# EasyEDA Pro project kuafu01_030内部老化方案.eprj, board PCB4 (continued)
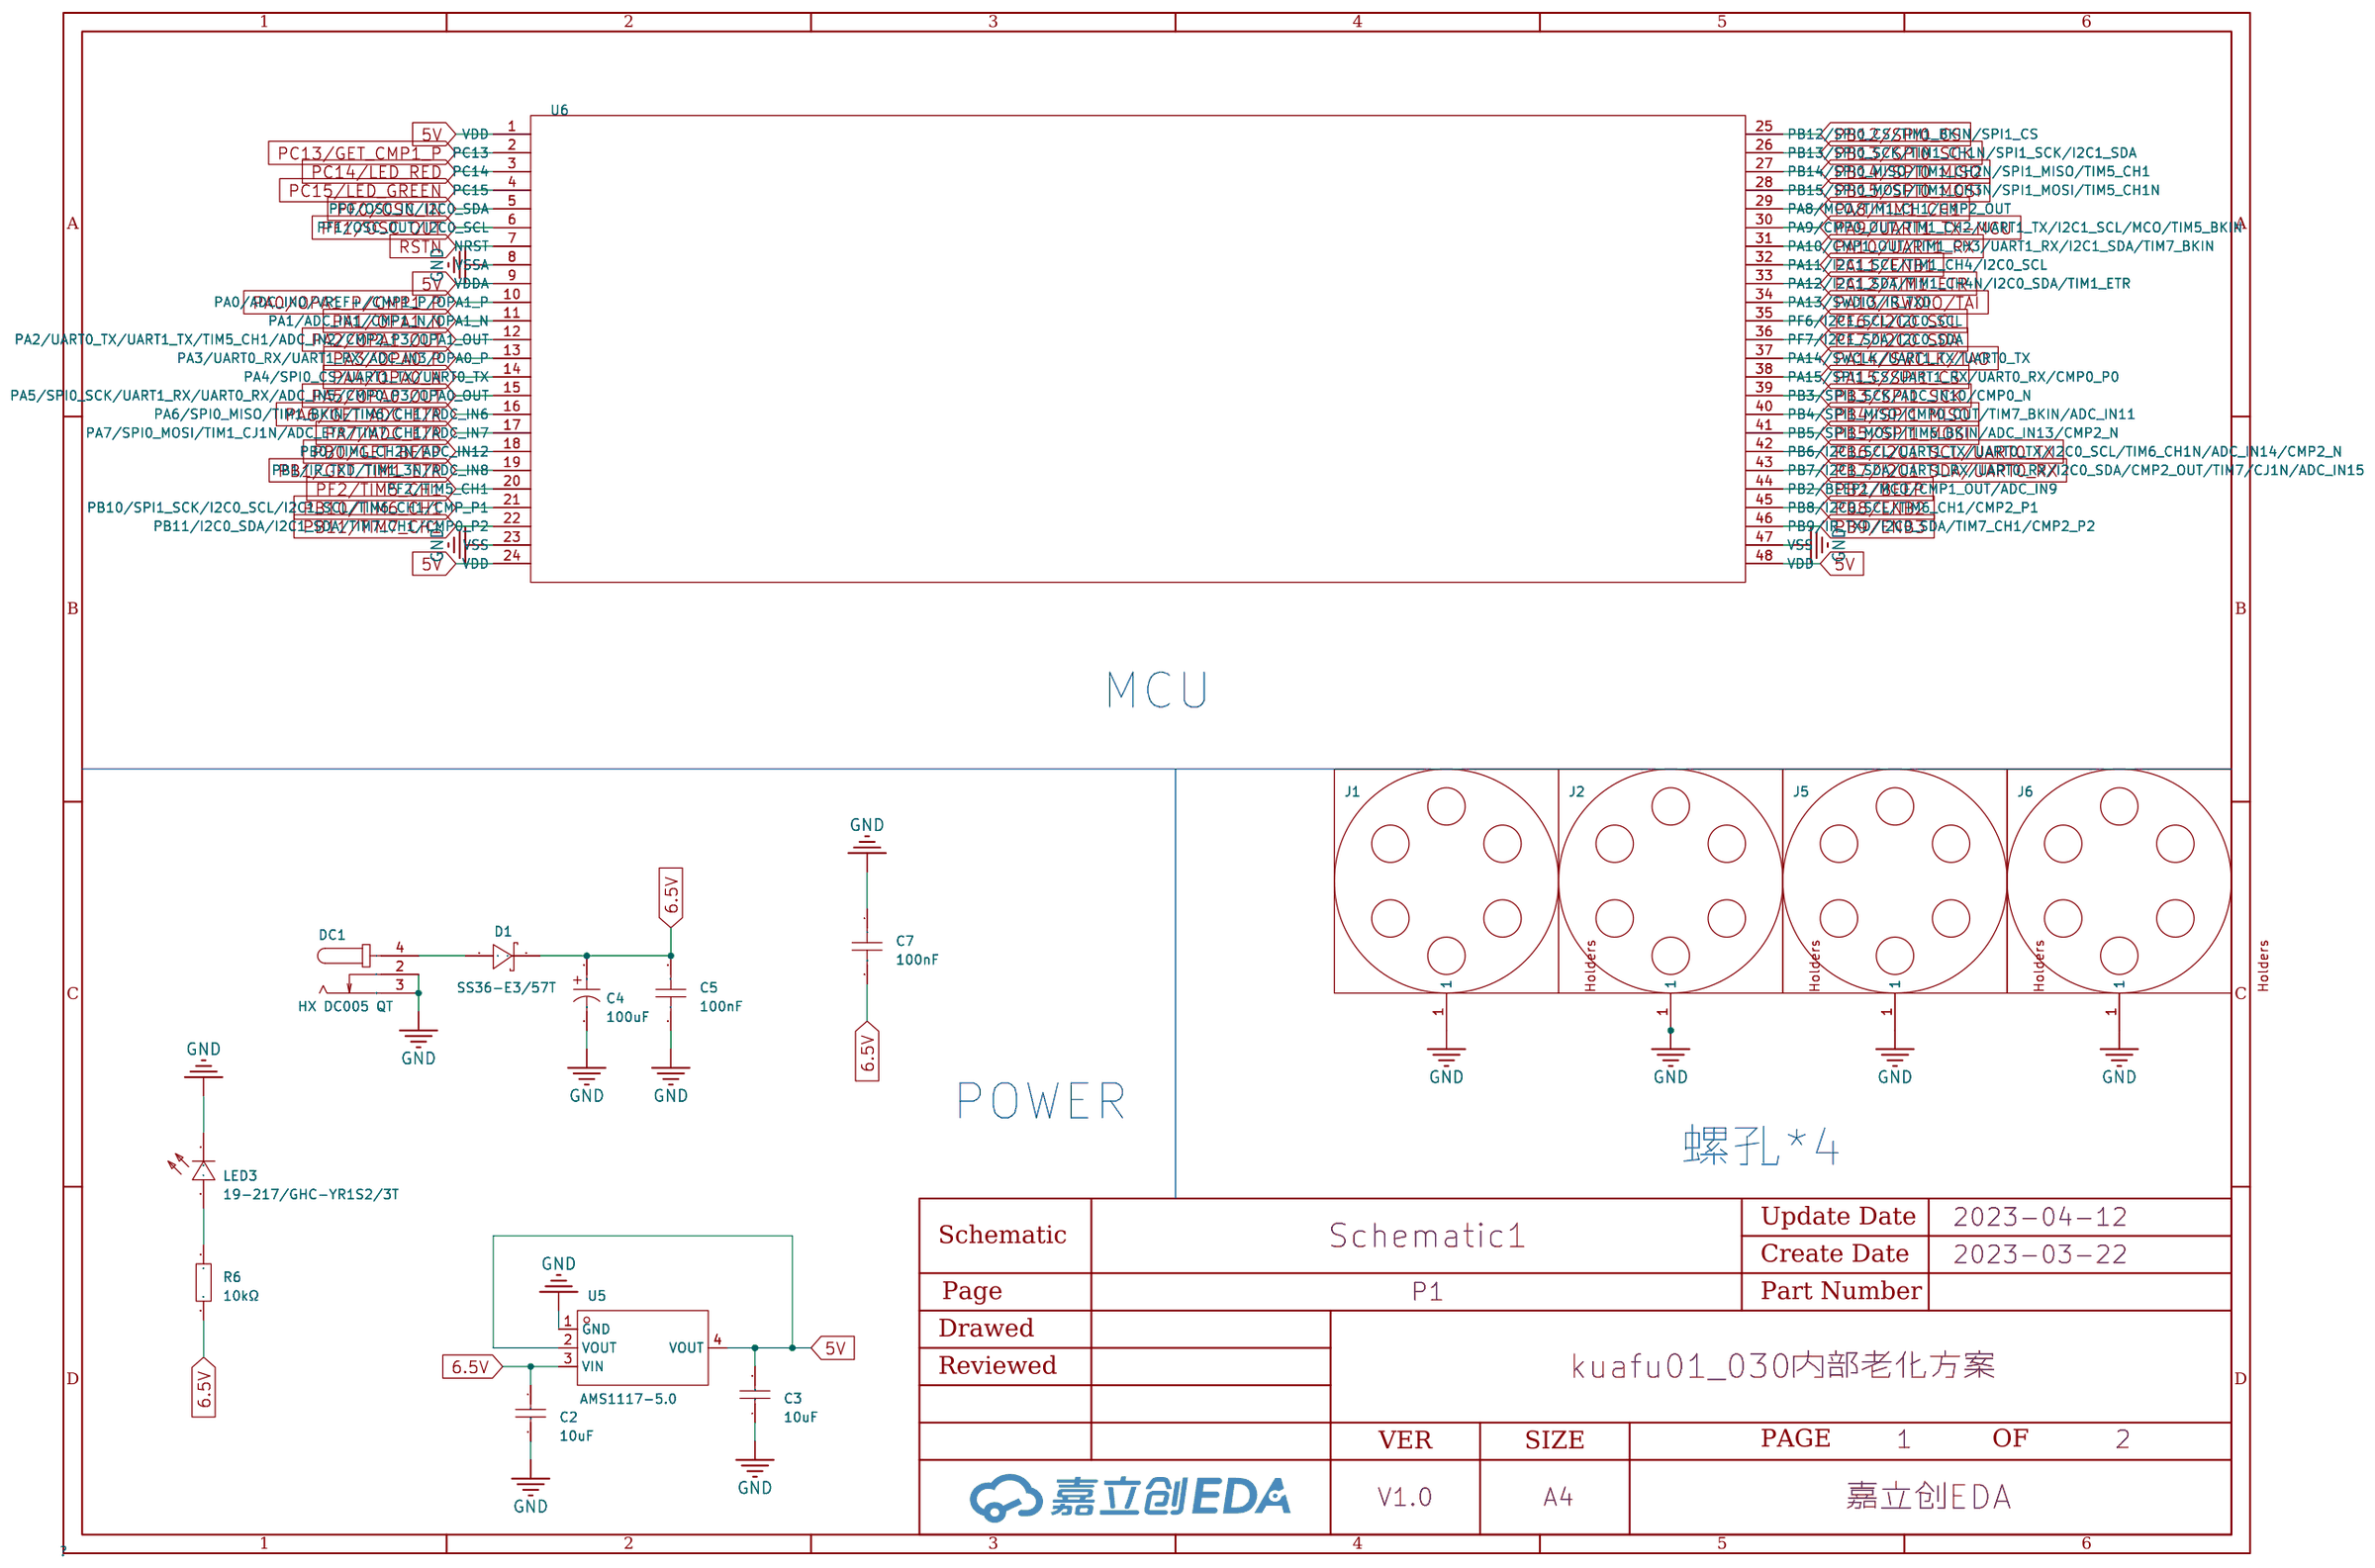
[diagram p0: P1]
## Routing (per net, layer and track width the routed paths; a pad name or vN(x,y) marks a point on that pad's centre or on a via; arc(x,y) is an arc through that point) (continued)
  Bottom Layer w0.254: v1(211.8,102.32) 211.9,102.22 211.9,94.96 221.88,84.97 221.88,79.05 v1(221.52,78.68) ; v1(272.31,332.68) 272.68,333.05 272.68,338.97 262.7,348.96 262.7,356.22 v1(262.6,356.32) ; v1(211.8,254.72) 211.9,254.62 211.9,247.36 221.88,237.37 221.88,231.45 v1(221.52,231.08) ; v1(213.67,291.07) 213.67,289.81 218.33,285.15 218.33,282.37 ; v1(59.4,254.72) 59.5,254.62 59.5,247.36 69.48,237.37 69.48,231.45 v1(69.11,231.08) ; v1(112.07,138.67) 112.07,137.41 116.73,132.75 116.73,129.97 ; v1(211.8,356.32) 211.9,356.22 211.9,348.96 221.88,338.97 221.88,333.05 v1(221.52,332.68) ; v1(69.11,129.48) 69.48,129.85 69.48,135.77 59.5,145.76 59.5,153.02 v1(59.4,153.12) ; 167.53,333.17 167.53,335.95 162.87,340.61 v1(162.87,341.88) ; 218.33,79.17 218.33,81.95 213.67,86.61 v1(213.67,87.88) ; v1(323.12,78.68) 323.48,79.05 323.48,84.97 313.5,94.96 313.5,102.22 v1(313.4,102.32) ; v1(110.2,51.52) 110.3,51.42 110.3,44.16 120.28,34.17 120.28,28.25 v1(119.91,27.88) ; 269.13,333.17 269.13,335.95 264.47,340.61 v1(264.47,341.88) ; v1(119.91,332.68) 120.28,333.05 120.28,338.97 110.3,348.96 110.3,356.22 v1(110.2,356.32) ; v1(313.4,254.72) 313.5,254.62 313.5,247.36 323.48,237.37 323.48,231.45 v1(323.12,231.08) ; v1(119.91,78.68) 120.28,79.05 120.28,84.97 110.3,94.96 110.3,102.22 v1(110.2,102.32) ; v1(162.87,138.67) 162.87,137.41 167.53,132.75 167.53,129.97 ; v1(59.4,203.92) 59.5,203.82 59.5,196.56 69.48,186.57 69.48,180.65 v1(69.11,180.28) ; 269.13,79.17 269.13,81.95 264.47,86.61 v1(264.47,87.88) ; v1(119.91,129.48) 120.28,129.85 120.28,135.77 110.3,145.76 110.3,153.02 v1(110.2,153.12) ; 65.93,28.37 65.93,31.15 61.27,35.81 v1(61.27,37.07) ; v1(161,153.12) 161.1,153.02 161.1,145.76 171.08,135.77 171.08,129.85 v1(170.72,129.48) ; v1(112.07,240.27) 112.07,239.01 116.73,234.35 116.73,231.57 ; v1(110.2,203.92) 110.3,203.82 110.3,196.56 120.28,186.57 120.28,180.65 v1(119.91,180.28) ; v1(170.72,78.68) 171.08,79.05 171.08,84.97 161.1,94.96 161.1,102.22 v1(161,102.32) ; 319.93,180.77 319.93,183.55 315.27,188.21 v1(315.27,189.47) ; v1(211.8,51.52) 211.9,51.42 211.9,44.16 221.88,34.17 221.88,28.25 v1(221.52,27.88) ; v1(61.27,87.88) 61.27,86.61 65.93,81.95 65.93,79.17 ; v1(110.2,254.72) 110.3,254.62 110.3,247.36 120.28,237.37 120.28,231.45 v1(119.91,231.08) ; v1(262.6,51.52) 262.7,51.42 262.7,44.16 272.68,34.17 272.68,28.25 v1(272.31,27.88) ; v1(59.4,305.52) 59.5,305.42 59.5,298.16 69.48,288.17 69.48,282.25 v1(69.11,281.88) ; v1(170.72,180.28) 171.08,180.65 171.08,186.57 161.1,196.56 161.1,203.82 v1(161,203.92) ; 269.13,231.57 269.13,234.35 264.47,239.01 v1(264.47,240.27) ; v1(61.27,138.67) 61.27,137.41 65.93,132.75 65.93,129.97 ; 65.93,180.77 65.93,183.55 61.27,188.21 v1(61.27,189.47) ; 269.13,28.37 269.13,31.15 264.47,35.81 v1(264.47,37.07) ; 116.73,333.17 116.73,335.95 112.07,340.61 v1(112.07,341.88) ; 167.53,231.57 167.53,234.35 162.87,239.01 v1(162.87,240.27) ; v1(313.4,203.92) 313.5,203.82 313.5,196.56 323.48,186.57 323.48,180.65 v1(323.12,180.28) ; 319.93,129.97 319.93,132.75 315.27,137.41 v1(315.27,138.67) ; v1(161,51.52) 161.1,51.42 161.1,44.16 171.08,34.17 171.08,28.25 v1(170.72,27.88) ; v1(315.27,341.88) 315.27,340.61 319.93,335.95 319.93,333.17 ; 65.93,282.37 65.93,285.15 61.27,289.81 v1(61.27,291.07) ; v1(262.6,203.92) 262.7,203.82 262.7,196.56 272.68,186.57 272.68,180.65 v1(272.31,180.28) ; v1(170.72,281.88) 171.08,282.25 171.08,288.17 161.1,298.16 161.1,305.42 v1(161,305.52) ; v1(69.11,78.68) 69.48,79.05 69.48,84.97 59.5,94.96 59.5,102.22 v1(59.4,102.32) ; 167.53,180.77 167.53,183.55 162.87,188.21 v1(162.87,189.47) ; v1(315.27,291.07) 315.27,289.81 319.93,285.15 319.93,282.37 ; 65.93,231.57 65.93,234.35 61.27,239.01 v1(61.27,240.27) ; v1(262.6,102.32) 262.7,102.22 262.7,94.96 272.68,84.97 272.68,79.05 v1(272.31,78.68) ; v1(110.2,305.52) 110.3,305.42 110.3,298.16 120.28,288.17 120.28,282.25 v1(119.91,281.88) ; v1(313.4,305.52) 313.5,305.42 313.5,298.16 323.48,288.17 323.48,282.25 v1(323.12,281.88) ; v1(272.31,231.08) 272.68,231.45 272.68,237.37 262.7,247.36 262.7,254.62 v1(262.6,254.72) ; v1(112.07,87.88) 112.07,86.61 116.73,81.95 116.73,79.17 ; v1(264.47,291.07) 264.47,289.81 269.13,285.15 269.13,282.37 ; v1(313.4,356.32) 313.5,356.22 313.5,348.96 323.48,338.97 323.48,333.05 v1(323.12,332.68) ; v1(112.07,189.47) 112.07,188.21 116.73,183.55 116.73,180.77 ; v1(313.4,153.12) 313.5,153.02 313.5,145.76 323.48,135.77 323.48,129.85 v1(323.12,129.48) ; v1(211.8,305.52) 211.9,305.42 211.9,298.16 221.88,288.17 221.88,282.25 v1(221.52,281.88) ; v1(170.72,332.68) 171.08,333.05 171.08,338.97 161.1,348.96 161.1,356.22 v1(161,356.32) ; v1(221.52,180.28) 221.88,180.65 221.88,186.57 211.9,196.56 211.9,203.82 v1(211.8,203.92) ; 116.73,28.37 116.73,31.15 112.07,35.81 v1(112.07,37.07) ; 218.33,129.97 218.33,132.75 213.67,137.41 v1(213.67,138.67) ; v1(221.52,129.48) 221.88,129.85 221.88,135.77 211.9,145.76 211.9,153.02 v1(211.8,153.12) ; 319.93,231.57 319.93,234.35 315.27,239.01 v1(315.27,240.27) ; 269.13,129.97 269.13,132.75 264.47,137.41 v1(264.47,138.67) ; 218.33,180.77 218.33,183.55 213.67,188.21 v1(213.67,189.47) ; v1(262.6,305.52) 262.7,305.42 262.7,298.16 272.68,288.17 272.68,282.25 v1(272.31,281.88) ; v1(162.87,37.07) 162.87,35.81 167.53,31.15 167.53,28.37 ; v1(162.87,87.88) 162.87,86.61 167.53,81.95 167.53,79.17 ; v1(162.87,291.07) 162.87,289.81 167.53,285.15 167.53,282.37 ; v1(213.67,37.07) 213.67,35.81 218.33,31.15 218.33,28.37 ; v1(112.07,291.07) 112.07,289.81 116.73,285.15 116.73,282.37 ; 319.93,79.17 319.93,81.95 315.27,86.61 v1(315.27,87.88) ; v1(272.31,129.48) 272.68,129.85 272.68,135.77 262.7,145.76 262.7,153.02 v1(262.6,153.12) ; v1(264.47,189.47) 264.47,188.21 269.13,183.55 269.13,180.77 ; v1(170.72,231.08) 171.08,231.45 171.08,237.37 161.1,247.36 161.1,254.62 v1(161,254.72) ; v1(69.11,27.88) 69.48,28.25 69.48,34.17 59.5,44.16 59.5,51.42 v1(59.4,51.52) ; 218.33,333.17 218.33,335.95 213.67,340.61 v1(213.67,341.88) ; v1(213.67,240.27) 213.67,239.01 218.33,234.35 218.33,231.57
PA10/UART1_RX: length 1261.4
  Top Layer w0.254: v1(161.57,240.25) 161.57,241.4 158.16,244.81 ; 259.06,77.79 266.28,77.79 268.13,79.63 268.13,80.01 v1(268.12,80.02) 268.14,80.04 268.14,80.99 266.85,82.28 264.69,82.28 ; 259.06,128.59 266.28,128.59 268.13,130.44 268.13,130.81 v1(268.12,130.82) 268.14,130.84 268.14,131.79 266.85,133.08 264.69,133.08 ; 310.56,143.21 313.97,139.8 v1(313.97,138.65) ; 107.36,92.41 110.77,89 v1(110.77,87.85) ; 208.26,179.39 215.48,179.39 217.33,181.23 217.33,181.61 v1(217.32,181.62) 217.34,181.64 217.34,182.59 216.05,183.88 213.89,183.88 ; v1(263.17,87.85) 263.17,89 259.76,92.41 ; v1(212.37,37.05) 212.37,38.2 208.96,41.61 ; 112.29,285.48 114.45,285.48 115.74,284.19 115.74,283.24 v1(115.72,283.22) 115.73,283.21 115.73,282.83 113.88,280.99 106.66,280.99 ; 208.96,295.61 212.37,292.2 v1(212.37,291.05) ; 264.69,234.68 266.85,234.68 268.14,233.39 268.14,232.44 v1(268.12,232.42) 268.13,232.41 268.13,232.03 266.28,230.19 259.06,230.19 ; v1(161.57,189.45) 161.57,190.6 158.16,194.01 ; 157.46,331.79 164.68,331.79 166.53,333.63 166.53,334.01 v1(166.52,334.02) 166.54,334.04 166.54,334.99 165.25,336.28 163.09,336.28 ; 55.86,77.79 63.08,77.79 64.93,79.63 64.93,80.01 v1(64.92,80.02) 64.94,80.04 64.94,80.99 63.65,82.28 61.49,82.28 ; 107.36,41.61 110.77,38.2 v1(110.77,37.05) ; 208.26,128.59 215.48,128.59 217.33,130.44 217.33,130.81 v1(217.32,130.82) 217.34,130.84 217.34,131.79 216.05,133.08 213.89,133.08 ; 55.86,128.59 63.08,128.59 64.93,130.44 64.93,130.81 v1(64.92,130.82) 64.94,130.84 64.94,131.79 63.65,133.08 61.49,133.08 ; 56.56,244.81 59.97,241.4 v1(59.97,240.25) ; 259.06,179.39 266.28,179.39 268.13,181.23 268.13,181.61 v1(268.12,181.62) 268.14,181.64 268.14,182.59 266.85,183.88 264.69,183.88 ; 264.69,336.28 266.85,336.28 268.14,334.99 268.14,334.04 v1(268.12,334.02) 268.13,334.01 268.13,333.63 266.28,331.79 259.06,331.79 ; 315.49,183.88 317.65,183.88 318.94,182.59 318.94,181.64 v1(318.92,181.62) 318.93,181.61 318.93,181.23 317.08,179.39 309.86,179.39 ; 264.69,31.48 266.85,31.48 268.14,30.19 268.14,29.24 v1(268.12,29.22) 268.13,29.21 268.13,28.83 266.28,26.99 259.06,26.99 ; 315.49,82.28 317.65,82.28 318.94,80.99 318.94,80.04 v1(318.92,80.02) 318.93,80.01 318.93,79.63 317.08,77.79 309.86,77.79 ; v1(110.77,240.25) 110.77,241.4 107.36,244.81 ; v1(263.17,37.05) 263.17,38.2 259.76,41.61 ; v1(212.37,138.65) 212.37,139.8 208.96,143.21 ; 259.76,194.01 263.17,190.6 v1(263.17,189.45) ; 107.36,194.01 110.77,190.6 v1(110.77,189.45) ; 157.46,26.99 164.68,26.99 166.53,28.83 166.53,29.21 v1(166.52,29.22) 166.54,29.24 166.54,30.19 165.25,31.48 163.09,31.48 ; 106.66,230.19 113.88,230.19 115.73,232.03 115.73,232.41 v1(115.72,232.42) 115.74,232.44 115.74,233.39 114.45,234.68 112.29,234.68 ; 106.66,26.99 113.88,26.99 115.73,28.83 115.73,29.21 v1(115.72,29.22) 115.74,29.24 115.74,30.19 114.45,31.48 112.29,31.48 ; 309.86,280.99 317.08,280.99 318.93,282.83 318.93,283.21 v1(318.92,283.22) 318.94,283.24 318.94,284.19 317.65,285.48 315.49,285.48 ; 208.26,26.99 215.48,26.99 217.33,28.83 217.33,29.21 v1(217.32,29.22) 217.34,29.24 217.34,30.19 216.05,31.48 213.89,31.48 ; 112.29,183.88 114.45,183.88 115.74,182.59 115.74,181.64 v1(115.72,181.62) 115.73,181.61 115.73,181.23 113.88,179.39 106.66,179.39 ; 157.46,179.39 164.68,179.39 166.53,181.23 166.53,181.61 v1(166.52,181.62) 166.54,181.64 166.54,182.59 165.25,183.88 163.09,183.88 ; 107.36,346.41 110.77,343 v1(110.77,341.85) ; v1(313.97,189.45) 313.97,190.6 310.56,194.01 ; 208.96,194.01 212.37,190.6 v1(212.37,189.45) ; 208.96,92.41 212.37,89 v1(212.37,87.85) ; v1(161.57,291.05) 161.57,292.2 158.16,295.61 ; 163.09,82.28 165.25,82.28 166.54,80.99 166.54,80.04 v1(166.52,80.02) 166.53,80.01 166.53,79.63 164.68,77.79 157.46,77.79 ; 309.86,230.19 317.08,230.19 318.93,232.03 318.93,232.41 v1(318.92,232.42) 318.94,232.44 318.94,233.39 317.65,234.68 315.49,234.68 ; 106.66,331.79 113.88,331.79 115.73,333.63 115.73,334.01 v1(115.72,334.02) 115.74,334.04 115.74,334.99 114.45,336.28 112.29,336.28 ; v1(313.97,240.25) 313.97,241.4 310.56,244.81 ; 106.66,128.59 113.88,128.59 115.73,130.44 115.73,130.81 v1(115.72,130.82) 115.74,130.84 115.74,131.79 114.45,133.08 112.29,133.08 ; 259.06,280.99 266.28,280.99 268.13,282.83 268.13,283.21 v1(268.12,283.22) 268.14,283.24 268.14,284.19 266.85,285.48 264.69,285.48 ; v1(263.17,341.85) 263.17,343 259.76,346.41 ; 61.49,234.68 63.65,234.68 64.94,233.39 64.94,232.44 v1(64.92,232.42) 64.93,232.41 64.93,232.03 63.08,230.19 55.86,230.19 ; 61.49,285.48 63.65,285.48 64.94,284.19 64.94,283.24 v1(64.92,283.22) 64.93,283.21 64.93,282.83 63.08,280.99 55.86,280.99 ; 208.96,244.81 212.37,241.4 v1(212.37,240.25) ; 213.89,234.68 216.05,234.68 217.34,233.39 217.34,232.44 v1(217.32,232.42) 217.33,232.41 217.33,232.03 215.48,230.19 208.26,230.19 ; 157.46,230.19 164.68,230.19 166.53,232.03 166.53,232.41 v1(166.52,232.42) 166.54,232.44 166.54,233.39 165.25,234.68 163.09,234.68 ; 259.76,295.61 263.17,292.2 v1(263.17,291.05) ; 61.49,183.88 63.65,183.88 64.94,182.59 64.94,181.64 v1(64.92,181.62) 64.93,181.61 64.93,181.23 63.08,179.39 55.86,179.39 ; 208.26,280.99 215.48,280.99 217.33,282.83 217.33,283.21 v1(217.32,283.22) 217.34,283.24 217.34,284.19 216.05,285.48 213.89,285.48 ; 158.16,143.21 161.57,139.8 v1(161.57,138.65) ; v1(161.57,87.85) 161.57,89 158.16,92.41 ; v1(161.57,37.05) 161.57,38.2 158.16,41.61 ; 315.49,133.08 317.65,133.08 318.94,131.79 318.94,130.84 v1(318.92,130.82) 318.93,130.81 318.93,130.44 317.08,128.59 309.86,128.59 ; 107.36,295.61 110.77,292.2 v1(110.77,291.05) ; 56.56,143.21 59.97,139.8 v1(59.97,138.65) ; 309.86,331.79 317.08,331.79 318.93,333.63 318.93,334.01 v1(318.92,334.02) 318.94,334.04 318.94,334.99 317.65,336.28 315.49,336.28 ; v1(59.97,291.05) 59.97,292.2 56.56,295.61 ; v1(110.77,138.65) 110.77,139.8 107.36,143.21 ; 163.09,285.48 165.25,285.48 166.54,284.19 166.54,283.24 v1(166.52,283.22) 166.53,283.21 166.53,282.83 164.68,280.99 157.46,280.99 ; 61.49,31.48 63.65,31.48 64.94,30.19 64.94,29.24 v1(64.92,29.22) 64.93,29.21 64.93,28.83 63.08,26.99 55.86,26.99 ; 213.89,336.28 216.05,336.28 217.34,334.99 217.34,334.04 v1(217.32,334.02) 217.33,334.01 217.33,333.63 215.48,331.79 208.26,331.79 ; 259.76,244.81 263.17,241.4 v1(263.17,240.25) ; 112.29,82.28 114.45,82.28 115.74,80.99 115.74,80.04 v1(115.72,80.02) 115.73,80.01 115.73,79.63 113.88,77.79 106.66,77.79 ; v1(313.97,291.05) 313.97,292.2 310.56,295.61 ; 157.46,128.59 164.68,128.59 166.53,130.44 166.53,130.81 v1(166.52,130.82) 166.54,130.84 166.54,131.79 165.25,133.08 163.09,133.08 ; 208.96,346.41 212.37,343 v1(212.37,341.85) ; v1(313.97,341.85) 313.97,343 310.56,346.41 ; 56.56,92.41 59.97,89 v1(59.97,87.85) ; 208.26,77.79 215.48,77.79 217.33,79.63 217.33,80.01 v1(217.32,80.02) 217.34,80.04 217.34,80.99 216.05,82.28 213.89,82.28 ; 310.56,92.41 313.97,89 v1(313.97,87.85) ; v1(59.97,189.45) 59.97,190.6 56.56,194.01 ; 158.16,346.41 161.57,343 v1(161.57,341.85) ; v1(263.17,138.65) 263.17,139.8 259.76,143.21 ; v1(59.97,37.05) 59.97,38.2 56.56,41.61
  Bottom Layer w0.254: v1(59.97,138.65) 59.97,137.63 65.53,132.08 65.53,131.45 64.92,130.84 v1(64.92,130.82) ; v1(166.52,334.02) 166.52,334.04 167.13,334.65 167.13,335.28 161.57,340.83 v1(161.57,341.85) ; v1(64.92,232.42) 64.92,232.44 65.53,233.05 65.53,233.68 59.97,239.23 v1(59.97,240.25) ; v1(217.32,80.02) 217.32,80.04 217.93,80.65 217.93,81.28 212.37,86.83 v1(212.37,87.85) ; v1(217.32,181.62) 217.32,181.64 217.93,182.25 217.93,182.88 212.37,188.44 v1(212.37,189.45) ; v1(110.77,138.65) 110.77,137.63 116.33,132.08 116.33,131.45 115.72,130.84 v1(115.72,130.82) ; v1(110.77,240.25) 110.77,239.23 116.33,233.68 116.33,233.05 115.72,232.44 v1(115.72,232.42) ; v1(115.72,181.62) 115.72,181.64 116.33,182.25 116.33,182.88 110.77,188.44 v1(110.77,189.45) ; v1(263.17,341.85) 263.17,340.83 268.73,335.28 268.73,334.65 268.12,334.04 v1(268.12,334.02) ; v1(161.57,240.25) 161.57,239.23 167.13,233.68 167.13,233.05 166.52,232.44 v1(166.52,232.42) ; v1(59.97,87.85) 59.97,86.83 65.53,81.28 65.53,80.65 64.92,80.04 v1(64.92,80.02) ; v1(110.77,37.05) 110.77,36.03 116.33,30.48 116.33,29.85 115.72,29.24 v1(115.72,29.22) ; v1(318.92,283.22) 318.92,283.24 319.53,283.85 319.53,284.48 313.97,290.03 v1(313.97,291.05) ; v1(59.97,291.05) 59.97,290.03 65.53,284.48 65.53,283.85 64.92,283.24 v1(64.92,283.22) ; v1(268.12,283.22) 268.12,283.24 268.73,283.85 268.73,284.48 263.17,290.03 v1(263.17,291.05) ; v1(64.92,181.62) 64.92,181.64 65.53,182.25 65.53,182.88 59.97,188.44 v1(59.97,189.45) ; v1(212.37,138.65) 212.37,137.63 217.93,132.08 217.93,131.45 217.32,130.84 v1(217.32,130.82) ; v1(313.97,138.65) 313.97,137.63 319.53,132.08 319.53,131.45 318.92,130.84 v1(318.92,130.82) ; v1(161.57,189.45) 161.57,188.44 167.13,182.88 167.13,182.25 166.52,181.64 v1(166.52,181.62) ; v1(161.57,87.85) 161.57,86.83 167.13,81.28 167.13,80.65 166.52,80.04 v1(166.52,80.02) ; v1(161.57,138.65) 161.57,137.63 167.13,132.08 167.13,131.45 166.52,130.84 v1(166.52,130.82) ; v1(313.97,87.85) 313.97,86.83 319.53,81.28 319.53,80.65 318.92,80.04 v1(318.92,80.02) ; v1(268.12,29.22) 268.12,29.24 268.73,29.85 268.73,30.48 263.17,36.03 v1(263.17,37.05) ; v1(64.92,29.22) 64.92,29.24 65.53,29.85 65.53,30.48 59.97,36.03 v1(59.97,37.05) ; v1(263.17,138.65) 263.17,137.63 268.73,132.08 268.73,131.45 268.12,130.84 v1(268.12,130.82) ; v1(166.52,29.22) 166.52,29.24 167.13,29.85 167.13,30.48 161.57,36.03 v1(161.57,37.05) ; v1(110.77,291.05) 110.77,290.03 116.33,284.48 116.33,283.85 115.72,283.24 v1(115.72,283.22) ; v1(217.32,232.42) 217.32,232.44 217.93,233.05 217.93,233.68 212.37,239.23 v1(212.37,240.25) ; v1(313.97,341.85) 313.97,340.83 319.53,335.28 319.53,334.65 318.92,334.04 v1(318.92,334.02) ; v1(268.12,80.02) 268.12,80.04 268.73,80.65 268.73,81.28 263.17,86.83 v1(263.17,87.85) ; v1(166.52,283.22) 166.52,283.24 167.13,283.85 167.13,284.48 161.57,290.03 v1(161.57,291.05) ; v1(212.37,341.85) 212.37,340.83 217.93,335.28 217.93,334.65 217.32,334.04 v1(217.32,334.02) ; v1(318.92,232.42) 318.92,232.44 319.53,233.05 319.53,233.68 313.97,239.23 v1(313.97,240.25) ; v1(268.12,181.62) 268.12,181.64 268.73,182.25 268.73,182.88 263.17,188.44 v1(263.17,189.45) ; v1(115.72,80.02) 115.72,80.04 116.33,80.65 116.33,81.28 110.77,86.83 v1(110.77,87.85) ; v1(212.37,291.05) 212.37,290.03 217.93,284.48 217.93,283.85 217.32,283.24 v1(217.32,283.22) ; v1(263.17,240.25) 263.17,239.23 268.73,233.68 268.73,233.05 268.12,232.44 v1(268.12,232.42) ; v1(212.37,37.05) 212.37,36.03 217.93,30.48 217.93,29.85 217.32,29.24 v1(217.32,29.22) ; v1(313.97,189.45) 313.97,188.44 319.53,182.88 319.53,182.25 318.92,181.64 v1(318.92,181.62) ; v1(115.72,334.02) 115.72,334.04 116.33,334.65 116.33,335.28 110.77,340.83 v1(110.77,341.85)
